# EasyEDA Pro project kuafu01_030内部老化方案_4.eprj, board PCB4 (continued)
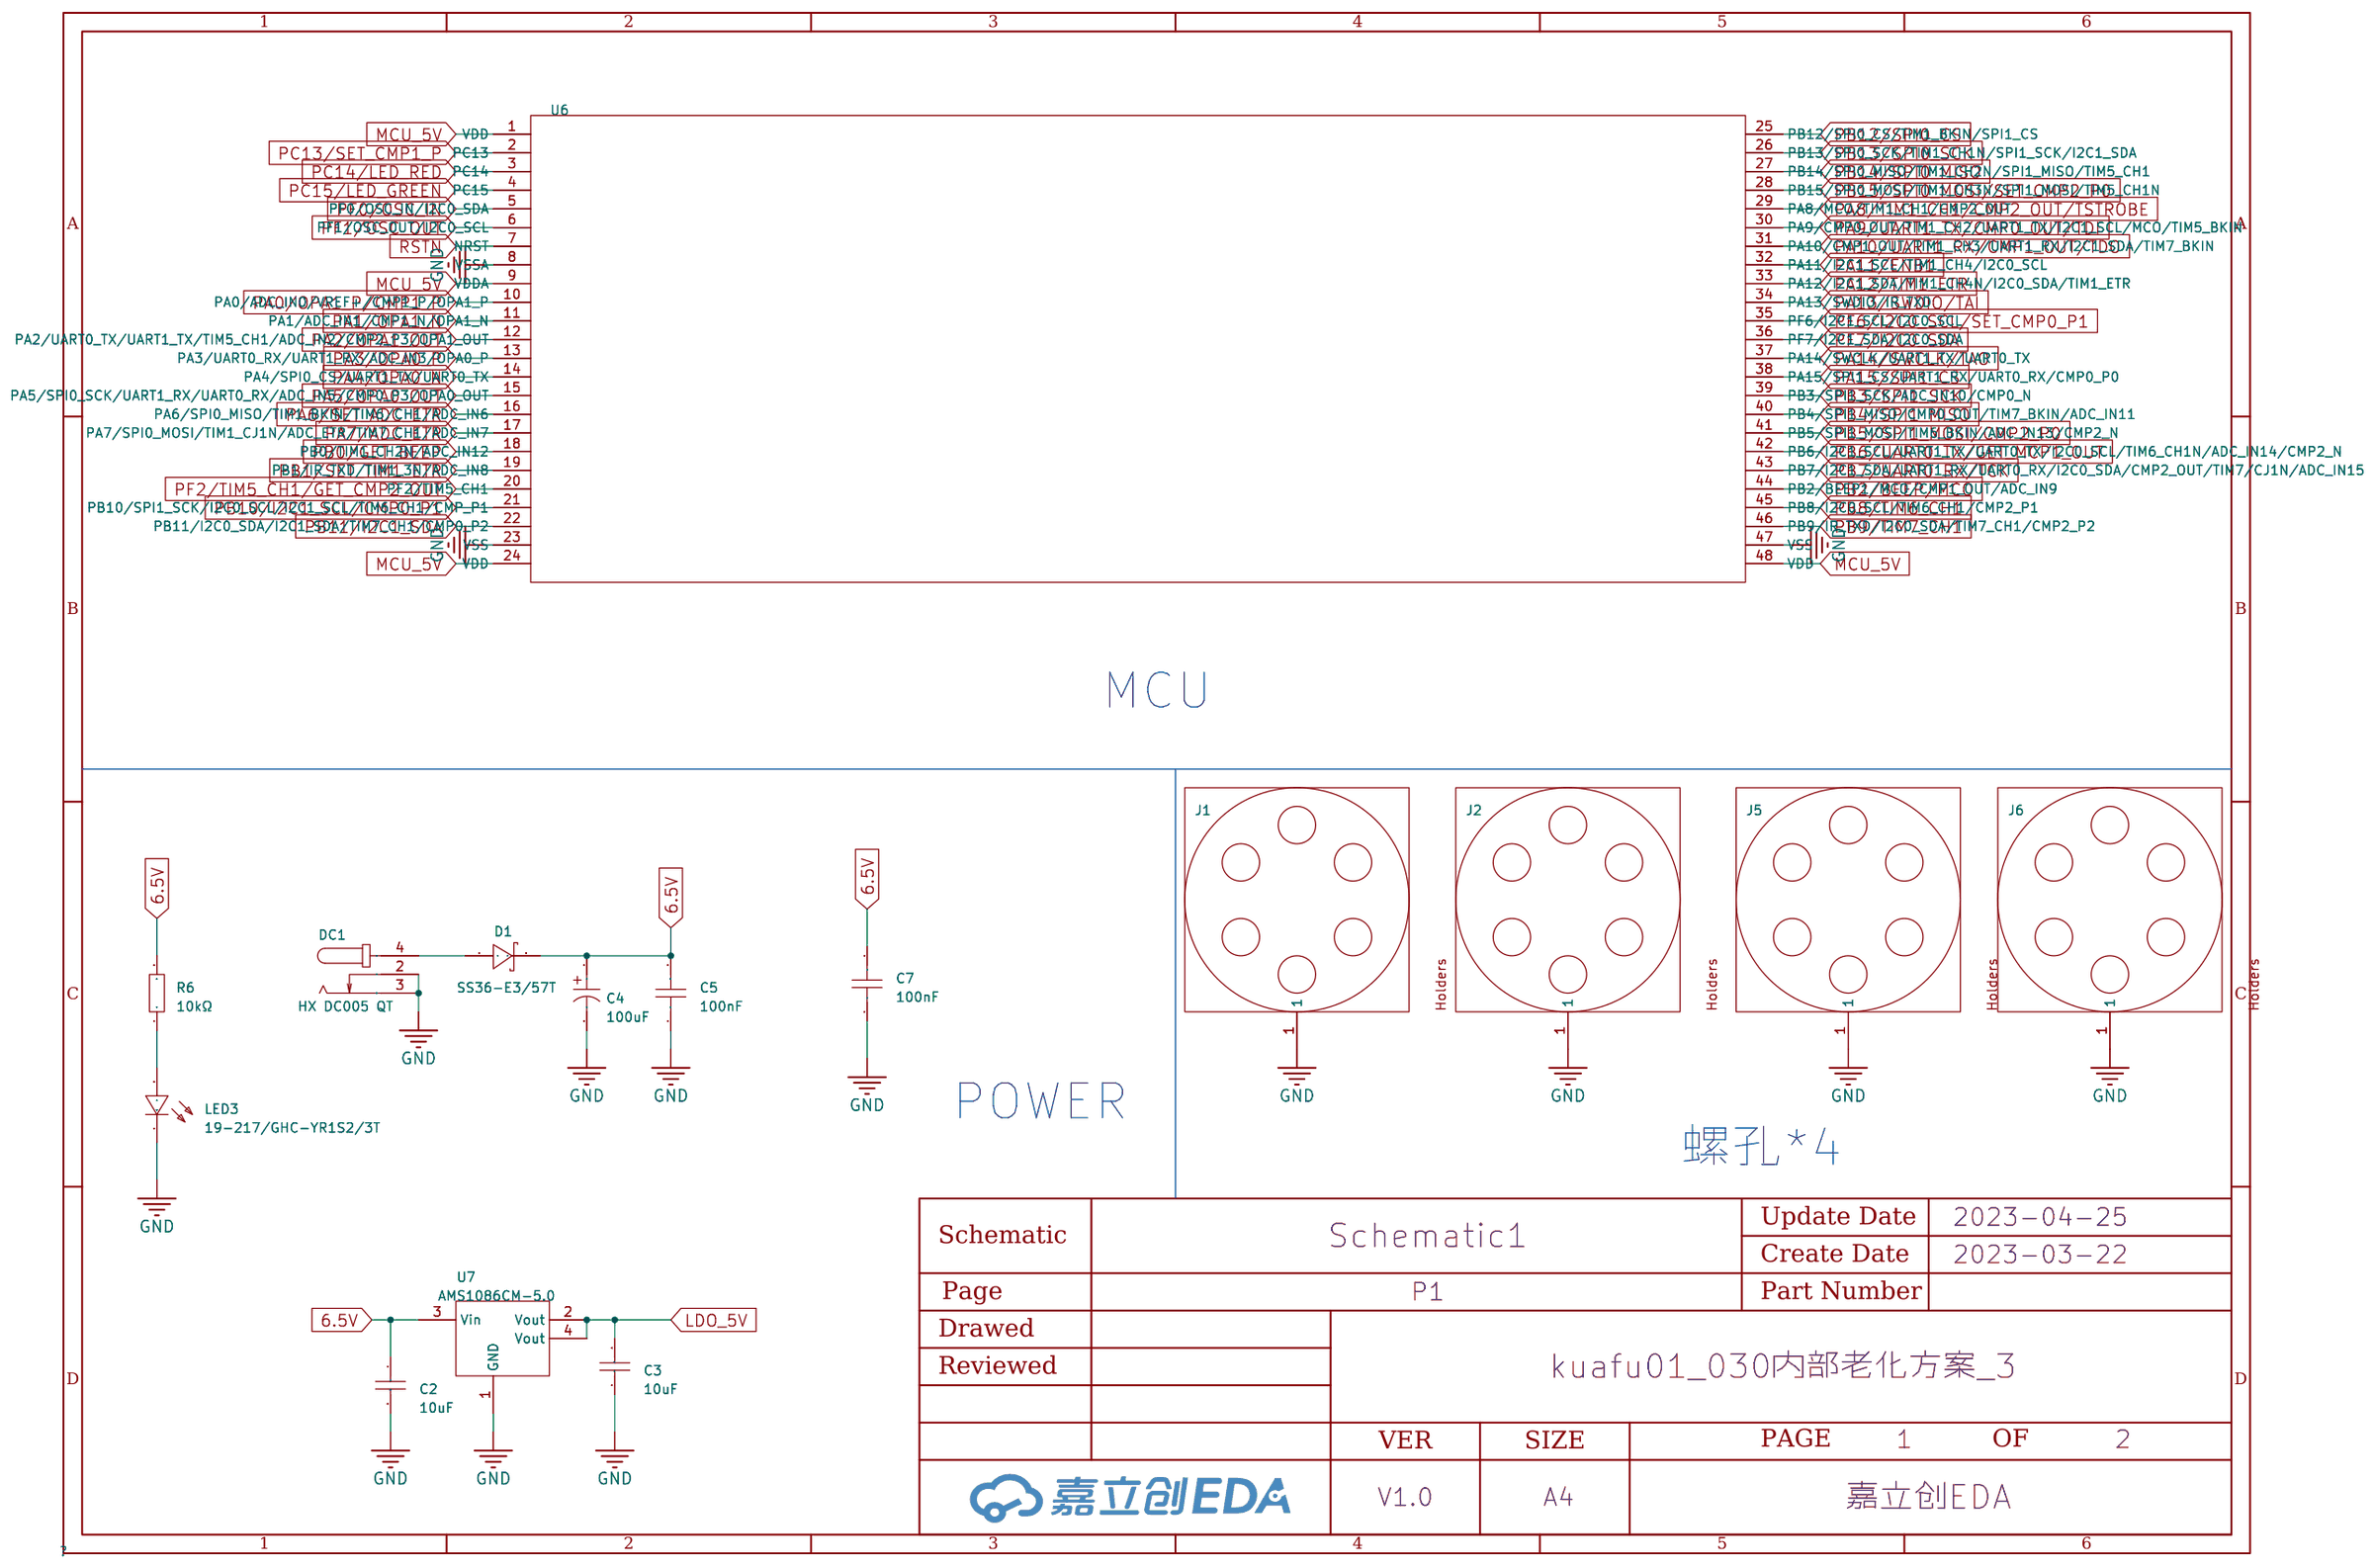
[diagram p0: P1]
## Routing (per net, layer and track width the routed paths; a pad name or vN(x,y) marks a point on that pad's centre or on a via; arc(x,y) is an arc through that point) (continued)
  Bottom Layer w0.28: v1(143.49,199.02) 143.5,199.03 v1(143.5,211.84) ; v1(244.58,86.25) 244.59,86.26 v1(244.59,99.07) ; v1(42.4,61.47) 42.4,48.66 v1(42.39,48.65) ; v1(143.5,61.47) 143.5,48.66 v1(143.49,48.65) ; v1(42.39,199.02) 42.4,199.03 v1(42.4,211.84) ; v1(244.58,123.84) 244.59,123.85 v1(244.59,136.66) ; v1(92.95,249.43) 92.95,236.62 v1(92.94,236.61) ; v1(42.4,249.43) 42.4,236.62 v1(42.39,236.61) ; v1(244.58,199.02) 244.59,199.03 v1(244.59,211.84) ; v1(42.39,123.84) 42.4,123.85 v1(42.4,136.66) ; v1(194.04,99.07) 194.04,86.26 v1(194.03,86.25) ; v1(194.03,161.43) 194.04,161.44 v1(194.04,174.25) ; v1(244.58,11.06) 244.59,11.07 v1(244.59,23.88) ; v1(143.5,249.43) 143.5,236.62 v1(143.49,236.61) ; v1(244.59,249.43) 244.59,236.62 v1(244.58,236.61) ; v1(42.4,99.07) 42.4,86.26 v1(42.39,86.25) ; v1(42.39,11.06) 42.4,11.07 v1(42.4,23.88) ; v1(92.94,161.43) 92.95,161.44 v1(92.95,174.25) ; v1(194.03,123.84) 194.04,123.85 v1(194.04,136.66) ; v1(194.03,199.02) 194.04,199.03 v1(194.04,211.84) ; v1(244.58,161.43) 244.59,161.44 v1(244.59,174.25) ; v1(244.58,48.65) 244.59,48.66 v1(244.59,61.47) ; v1(194.03,48.65) 194.04,48.66 v1(194.04,61.47) ; v1(42.39,161.43) 42.4,161.44 v1(42.4,174.25) ; v1(143.49,123.84) 143.5,123.85 v1(143.5,136.66) ; v1(194.04,249.43) 194.04,236.62 v1(194.03,236.61) ; v1(92.94,86.25) 92.95,86.26 v1(92.95,99.07) ; v1(92.94,199.02) 92.95,199.03 v1(92.95,211.84) ; v1(92.95,136.66) 92.95,123.85 v1(92.94,123.84) ; v1(143.49,161.43) 143.5,161.44 v1(143.5,174.25) ; v1(92.95,61.47) 92.95,48.66 v1(92.94,48.65) ; v1(143.5,99.07) 143.5,86.26 v1(143.49,86.25)
PA9/UART1_TX/CMP0_OUT/TDI: length 1156.4
  Top Layer w0.28: CN1#2.3 179.83,173.24 180.22,172.85 191.4,172.85 191.98,173.44 193.42,173.44 v1(193.44,173.46) ; v1(142.9,173.46) 142.88,173.44 141.44,173.44 140.85,172.85 129.67,172.85 129.29,173.24 CN1#7.3 ; v1(243.99,135.87) 243.97,135.85 242.53,135.85 241.94,135.26 230.76,135.26 230.38,135.65 CN1.3 ; U6#24.30 244.74,12.06 H4#23.1 ; v1(41.8,98.28) 41.78,98.26 40.34,98.26 39.76,97.67 28.58,97.67 28.19,98.05 CN1#14.3 ; v1(92.35,248.64) 92.33,248.62 90.89,248.62 90.3,248.04 79.12,248.04 78.74,248.42 CN1#32.3 ; U6#3.30 42.55,124.83 H4#3.1 ; U6#23.30 42.55,12.06 H4#22.1 ; v1(41.8,211.05) 41.78,211.03 40.34,211.03 39.76,210.45 28.58,210.45 28.19,210.83 CN1#27.3 ; CN1#20.3 78.74,98.05 79.12,97.67 90.3,97.67 90.89,98.26 92.33,98.26 v1(92.35,98.28) ; H4#6.1 194.19,124.83 U6#7.30 ; U6#20.30 42.55,87.24 H4#13.1 ; v1(142.9,248.64) 142.88,248.62 141.44,248.62 140.85,248.04 129.67,248.04 129.29,248.42 CN1#11.3 ; H4#32.1 93.1,237.61 U6.30 ; v1(142.9,98.28) 142.88,98.26 141.44,98.26 140.85,97.67 129.67,97.67 129.29,98.05 CN1#18.3 ; U6#32.30 194.19,200.02 H4#31.1 ; v1(243.99,248.64) 243.97,248.62 242.53,248.62 241.94,248.04 230.76,248.04 230.38,248.42 CN1#26.3 ; U6#10.30 194.19,162.42 H4#11.1 ; v1(243.99,173.46) 243.97,173.44 242.53,173.44 241.94,172.85 230.76,172.85 230.38,173.24 CN1#6.3 ; v1(92.35,135.87) 92.33,135.85 90.89,135.85 90.3,135.26 79.12,135.26 78.74,135.65 CN1#5.3 ; v1(92.35,211.05) 92.33,211.03 90.89,211.03 90.3,210.45 79.12,210.45 78.74,210.83 CN1#30.3 ; U6#25.30 194.19,237.61 H4#24.1 ; CN1#15.3 28.19,60.46 28.58,60.08 39.76,60.08 40.34,60.66 41.78,60.66 v1(41.8,60.68) ; H4#26.1 244.74,237.61 U6#26.30 ; H4#14.1 42.55,49.65 U6#14.30 ; v1(243.99,211.05) 243.97,211.03 242.53,211.03 241.94,210.45 230.76,210.45 230.38,210.83 CN1#29.3 ; H4#9.1 143.65,162.42 U6#8.30 ; U6#5.30 93.1,124.83 H4.1 ; CN1#31.3 129.29,210.83 129.67,210.45 140.85,210.45 141.44,211.03 142.88,211.03 v1(142.9,211.05) ; H4#17.1 194.19,49.65 U6#18.30 ; H4#2.1 42.55,162.42 U6#9.30 ; v1(142.9,60.68) 142.88,60.66 141.44,60.66 140.85,60.08 129.67,60.08 129.29,60.46 CN1#19.3 ; v1(142.9,135.87) 142.88,135.85 141.44,135.85 140.85,135.26 129.67,135.26 129.29,135.65 CN1#8.3 ; H4#30.1 143.65,200.02 U6#30.30 ; v1(193.44,135.87) 193.42,135.85 191.98,135.85 191.4,135.26 180.22,135.26 179.83,135.65 CN1#10.3 ; v1(193.44,211.05) 193.42,211.03 191.98,211.03 191.4,210.45 180.22,210.45 179.83,210.83 CN1#28.3 ; v1(193.44,98.28) 193.42,98.26 191.98,98.26 191.4,97.67 180.22,97.67 179.83,98.05 CN1#13.3 ; H4#20.1 143.65,87.24 U6#19.30 ; H4#7.1 244.74,162.42 U6#6.30 ; CN1#21.3 179.83,60.46 180.22,60.08 191.4,60.08 191.98,60.66 193.42,60.66 v1(193.44,60.68) ; H4#4.1 143.65,124.83 U6#2.30 ; v1(41.8,173.46) 41.78,173.44 40.34,173.44 39.76,172.85 28.58,172.85 28.19,173.24 CN1#3.3 ; H4#19.1 93.1,87.24 U6#22.30 ; H4#15.1 143.65,49.65 U6#13.30 ; H4#12.1 93.1,49.65 U6#16.30 ; CN1#17.3 230.38,98.05 230.76,97.67 241.94,97.67 242.53,98.26 243.97,98.26 v1(243.99,98.28) ; H4#5.1 244.74,124.83 U6#4.30 ; CN1#25.3 179.83,248.42 180.22,248.04 191.4,248.04 191.98,248.62 193.42,248.62 v1(193.44,248.64) ; v1(41.8,248.64) 41.78,248.62 40.34,248.62 39.76,248.04 28.58,248.04 28.19,248.42 CN1#24.3 ; H4#18.1 244.74,87.24 U6#17.30 ; v1(92.35,60.68) 92.33,60.66 90.89,60.66 90.3,60.08 79.12,60.08 78.74,60.46 CN1#16.3 ; v1(41.8,23.09) 41.78,23.07 40.34,23.07 39.76,22.49 28.58,22.49 28.19,22.87 CN1#22.3 ; H4#28.1 42.55,200.02 U6#31.30 ; U6#29.30 93.1,200.02 H4#29.1 ; CN1#9.3 78.74,173.24 79.12,172.85 90.3,172.85 90.89,173.44 92.33,173.44 v1(92.35,173.46) ; U6#15.30 244.74,49.65 H4#16.1 ; v1(243.99,60.68) 243.97,60.66 242.53,60.66 241.94,60.08 230.76,60.08 230.38,60.46 CN1#12.3 ; H4#25.1 42.55,237.61 U6#27.30 ; H4#21.1 194.19,87.24 U6#21.30 ; U6#12.30 143.65,237.61 H4#10.1 ; CN1#23.3 230.38,22.87 230.76,22.49 241.94,22.49 242.53,23.07 243.97,23.07 v1(243.99,23.09) ; H4#8.1 93.1,162.42 U6#11.30 ; v1(41.8,135.87) 41.78,135.85 40.34,135.85 39.76,135.26 28.58,135.26 28.19,135.65 CN1#4.3 ; U6#28.30 244.74,200.02 H4#27.1
  Bottom Layer w0.28: v1(243.99,173.46) 243.99,162.46 v1(243.98,162.45) ; v1(193.44,248.64) 193.44,237.64 v1(193.43,237.63) ; v1(142.89,200.04) 142.9,200.05 v1(142.9,211.05) ; v1(41.8,173.46) 41.8,162.46 v1(41.79,162.45) ; v1(243.98,237.63) 243.99,237.64 v1(243.99,248.64) ; v1(142.89,162.45) 142.9,162.46 v1(142.9,173.46) ; v1(243.99,135.87) 243.99,124.87 v1(243.98,124.86) ; v1(41.8,23.09) 41.8,12.09 v1(41.79,12.08) ; v1(142.9,135.87) 142.9,124.87 v1(142.89,124.86) ; v1(243.98,12.08) 243.99,12.09 v1(243.99,23.09) ; v1(41.79,200.04) 41.8,200.05 v1(41.8,211.05) ; v1(142.89,49.67) 142.9,49.68 v1(142.9,60.68) ; v1(243.99,211.05) 243.99,200.05 v1(243.98,200.04) ; v1(92.35,173.46) 92.35,162.46 v1(92.34,162.45) ; v1(193.44,173.46) 193.44,162.46 v1(193.43,162.45) ; v1(193.43,124.86) 193.44,124.87 v1(193.44,135.87) ; v1(142.9,248.64) 142.9,237.64 v1(142.89,237.63) ; v1(92.34,124.86) 92.35,124.87 v1(92.35,135.87) ; v1(193.43,200.04) 193.44,200.05 v1(193.44,211.05) ; v1(41.8,60.68) 41.8,49.68 v1(41.79,49.67) ; v1(92.34,87.27) 92.35,87.28 v1(92.35,98.28) ; v1(193.44,98.28) 193.44,87.28 v1(193.43,87.27) ; v1(41.79,237.63) 41.8,237.64 v1(41.8,248.64) ; v1(243.98,49.67) 243.99,49.68 v1(243.99,60.68) ; v1(92.34,237.63) 92.35,237.64 v1(92.35,248.64) ; v1(92.34,200.04) 92.35,200.05 v1(92.35,211.05) ; v1(142.9,98.28) 142.9,87.28 v1(142.89,87.27) ; v1(243.99,98.28) 243.99,87.28 v1(243.98,87.27) ; v1(193.44,60.68) 193.44,49.68 v1(193.43,49.67) ; v1(92.34,49.67) 92.35,49.68 v1(92.35,60.68) ; v1(41.8,135.87) 41.8,124.87 v1(41.79,124.86) ; v1(41.8,98.28) 41.8,87.28 v1(41.79,87.27)
PA10/UART1_RX/CMP1_OUT/TDO: length 1173.2
  Top Layer w0.28: U6#9.31 41.15,162.92 41.55,163.32 H3#6.1 ; v1(41.2,135.23) 40.33,135.23 39.94,134.83 26.14,134.83 25.65,135.32 CN1#4.1 ; U6#29.31 91.69,200.52 92.09,200.91 H3#30.1 ; U6#4.31 243.33,125.33 243.73,125.73 H3#7.1 ; v1(41.2,248) 40.33,248 39.94,247.61 26.14,247.61 25.65,248.09 CN1#24.1 ; CN1#20.1 76.2,97.72 76.69,97.24 90.48,97.24 90.88,97.64 v1(91.75,97.64) ; CN1#17.1 227.84,97.72 228.32,97.24 242.12,97.24 242.52,97.64 v1(243.39,97.64) ; v1(142.3,210.41) 141.43,210.41 141.03,210.01 127.23,210.01 126.75,210.5 CN1#31.1 ; U6#14.31 41.15,50.15 41.55,50.55 H3#14.1 ; H3#3.1 41.55,125.73 41.15,125.33 U6#3.31 ; U6#30.31 142.24,200.52 142.64,200.91 H3#31.1 ; v1(243.39,22.45) 242.52,22.45 242.12,22.05 228.32,22.05 227.84,22.54 CN1#23.1 ; U6#31.31 41.15,200.52 41.55,200.91 H3#29.1 ; v1(91.75,60.04) 90.88,60.04 90.48,59.65 76.69,59.65 76.2,60.13 CN1#16.1 ; U6#11.31 91.69,162.92 92.09,163.32 H3#10.1 ; U6#13.31 142.24,50.15 142.64,50.55 H3#16.1 ; U6#22.31 91.69,87.74 92.09,88.14 H3#21.1 ; v1(192.84,97.64) 191.97,97.64 191.57,97.24 177.78,97.24 177.29,97.72 CN1#13.1 ; U6#19.31 142.24,87.74 142.64,88.14 H3#20.1 ; v1(41.2,60.04) 40.33,60.04 39.94,59.65 26.14,59.65 25.65,60.13 CN1#15.1 ; CN1#28.1 177.29,210.5 177.78,210.01 191.57,210.01 191.97,210.41 v1(192.84,210.41) ; H3#4.1 243.73,163.32 243.33,162.92 U6#6.31 ; v1(91.75,135.23) 90.88,135.23 90.48,134.83 76.69,134.83 76.2,135.32 CN1#5.1 ; H3#13.1 92.09,50.55 91.69,50.15 U6#16.31 ; v1(91.75,172.82) 90.88,172.82 90.48,172.42 76.69,172.42 76.2,172.91 CN1#9.1 ; v1(192.84,248) 191.97,248 191.57,247.61 177.78,247.61 177.29,248.09 CN1#25.1 ; U6#32.31 192.79,200.52 193.18,200.91 H3#32.1 ; H3#28.1 243.73,200.91 243.33,200.52 U6#28.31 ; CN1#14.1 25.65,97.72 26.14,97.24 39.94,97.24 40.33,97.64 v1(41.2,97.64) ; CN1#3.1 25.65,172.91 26.14,172.42 39.94,172.42 40.33,172.82 v1(41.2,172.82) ; v1(243.39,172.82) 242.52,172.82 242.12,172.42 228.32,172.42 227.84,172.91 CN1#6.1 ; U6#17.31 243.33,87.74 243.73,88.14 H3#15.1 ; U6#10.31 192.79,162.92 193.18,163.32 H3#11.1 ; U6#18.31 192.79,50.15 193.18,50.55 H3#19.1 ; v1(91.75,210.41) 90.88,210.41 90.48,210.01 76.69,210.01 76.2,210.5 CN1#30.1 ; H3#27.1 243.73,238.51 243.33,238.11 U6#26.31 ; CN1#7.1 126.75,172.91 127.23,172.42 141.03,172.42 141.43,172.82 v1(142.3,172.82) ; H3#22.1 193.18,88.14 192.79,87.74 U6#21.31 ; H3#2.1 92.09,125.73 91.69,125.33 U6#5.31 ; H3#26.1 193.18,238.51 192.79,238.11 U6#25.31 ; H3#18.1 243.73,50.55 243.33,50.15 U6#15.31 ; U6#12.31 142.24,238.11 142.64,238.51 H3#12.1 ; CN1#29.1 227.84,210.5 228.32,210.01 242.12,210.01 242.52,210.41 v1(243.39,210.41) ; CN1#27.1 25.65,210.5 26.14,210.01 39.94,210.01 40.33,210.41 v1(41.2,210.41) ; H3#23.1 41.55,12.95 41.15,12.56 U6#23.31 ; U6#24.31 243.33,12.56 243.73,12.95 H3#24.1 ; CN1#10.1 177.29,135.32 177.78,134.83 191.57,134.83 191.97,135.23 v1(192.84,135.23) ; v1(142.3,248) 141.43,248 141.03,247.61 127.23,247.61 126.75,248.09 CN1#11.1 ; v1(243.39,135.23) 242.52,135.23 242.12,134.83 228.32,134.83 227.84,135.32 CN1.1 ; CN1#22.1 25.65,22.54 26.14,22.05 39.94,22.05 40.33,22.45 v1(41.2,22.45) ; v1(192.84,172.82) 191.97,172.82 191.57,172.42 177.78,172.42 177.29,172.91 CN1#2.1 ; U6#2.31 142.24,125.33 142.64,125.73 H3#5.1 ; v1(142.3,60.04) 141.43,60.04 141.03,59.65 127.23,59.65 126.75,60.13 CN1#19.1 ; H3.1 92.09,238.51 91.69,238.11 U6.31 ; U6#8.31 142.24,162.92 142.64,163.32 H3#9.1 ; H3#25.1 41.55,238.51 41.15,238.11 U6#27.31 ; v1(142.3,97.64) 141.43,97.64 141.03,97.24 127.23,97.24 126.75,97.72 CN1#18.1 ; v1(243.39,60.04) 242.52,60.04 242.12,59.65 228.32,59.65 227.84,60.13 CN1#12.1 ; v1(142.3,135.23) 141.43,135.23 141.03,134.83 127.23,134.83 126.75,135.32 CN1#8.1 ; v1(192.84,60.04) 191.97,60.04 191.57,59.65 177.78,59.65 177.29,60.13 CN1#21.1 ; v1(91.75,248) 90.88,248 90.48,247.61 76.69,247.61 76.2,248.09 CN1#32.1 ; H3#8.1 193.18,125.73 192.79,125.33 U6#7.31 ; H3#17.1 41.55,88.14 41.15,87.74 U6#20.31 ; v1(243.39,248) 242.52,248 242.12,247.61 228.32,247.61 227.84,248.09 CN1#26.1
  Bottom Layer w0.28: v1(243.37,238.18) 243.39,238.2 v1(243.39,248) ; v1(91.75,60.04) 91.75,50.24 v1(91.73,50.22) ; v1(142.3,60.04) 142.3,50.24 v1(142.28,50.22) ; v1(192.82,50.22) 192.84,50.24 v1(192.84,60.04) ; v1(243.37,87.82) 243.39,87.84 v1(243.39,97.64) ; v1(243.37,163) 243.39,163.02 v1(243.39,172.82) ; v1(243.37,125.41) 243.39,125.43 v1(243.39,135.23) ; v1(142.3,172.82) 142.3,163.02 v1(142.28,163) ; v1(41.2,135.23) 41.2,125.43 v1(41.18,125.41) ; v1(41.18,12.63) 41.2,12.65 v1(41.2,22.45) ; v1(142.3,248) 142.3,238.2 v1(142.28,238.18) ; v1(243.37,50.22) 243.39,50.24 v1(243.39,60.04) ; v1(91.73,163) 91.75,163.02 v1(91.75,172.82) ; v1(41.2,248) 41.2,238.2 v1(41.18,238.18) ; v1(91.75,248) 91.75,238.2 v1(91.73,238.18) ; v1(91.75,135.23) 91.75,125.43 v1(91.73,125.41) ; v1(192.84,97.64) 192.84,87.84 v1(192.82,87.82) ; v1(192.84,210.41) 192.84,200.61 v1(192.82,200.59) ; v1(192.84,248) 192.84,238.2 v1(192.82,238.18) ; v1(41.18,50.22) 41.2,50.24 v1(41.2,60.04) ; v1(142.28,200.59) 142.3,200.61 v1(142.3,210.41) ; v1(41.2,172.82) 41.2,163.02 v1(41.18,163) ; v1(192.84,172.82) 192.84,163.02 v1(192.82,163) ; v1(243.39,22.45) 243.39,12.65 v1(243.37,12.63) ; v1(243.37,200.59) 243.39,200.61 v1(243.39,210.41) ; v1(142.3,135.23) 142.3,125.43 v1(142.28,125.41) ; v1(41.18,87.82) 41.2,87.84 v1(41.2,97.64) ; v1(142.28,87.82) 142.3,87.84 v1(142.3,97.64) ; v1(192.84,135.23) 192.84,125.43 v1(192.82,125.41) ; v1(41.2,210.41) 41.2,200.61 v1(41.18,200.59) ; v1(91.73,200.59) 91.75,200.61 v1(91.75,210.41) ; v1(91.75,97.64) 91.75,87.84 v1(91.73,87.82)
PA11/ENB1: length 325.5
  Top Layer w0.28: U6#12.32 141.69,238.61 144.12,241.05 H6#12.2 ; H6#25.2 43.03,241.05 40.59,238.61 U6#27.32 ; H6#4.2 43.03,128.27 40.59,125.83 U6#3.32 ; H6#20.2 144.12,90.68 141.69,88.24 U6#19.32 ; U6#30.32 141.69,201.02 144.12,203.45 H6#30.2 ; H6#10.2 194.67,165.86 192.23,163.42 U6#10.32 ; H6#13.2 93.58,53.09 91.14,50.65 U6#16.32 ; U6.32 91.14,238.61 93.58,241.05 H6.2 ; H6#2.2 93.58,128.27 91.14,125.83 U6#5.32 ; U6#15.32 242.78,50.65 245.22,53.09 H6#18.2 ; H6#24.2 245.22,15.49 242.78,13.06 U6#24.32 ; H6#31.2 194.67,203.45 192.23,201.02 U6#32.32 ; H6#23.2 43.03,15.49 40.59,13.06 U6#23.32 ; U6#9.32 40.59,163.42 43.03,165.86 H6#3.2 ; H6#22.2 93.58,90.68 91.14,88.24 U6#22.32 ; H6#17.2 144.12,53.09 141.69,50.65 U6#13.32 ; H6#14.2 43.03,90.68 40.59,88.24 U6#20.32 ; U6#8.32 141.69,163.42 144.12,165.86 H6#9.2 ; H6#7.2 245.22,128.27 242.78,125.83 U6#4.32 ; U6#6.32 242.78,163.42 245.22,165.86 H6#5.2 ; H6#29.2 43.03,203.45 40.59,201.02 U6#31.32 ; H6#28.2 245.22,203.45 242.78,201.02 U6#28.32 ; U6#14.32 40.59,50.65 43.03,53.09 H6#15.2 ; U6#18.32 192.23,50.65 194.67,53.09 H6#19.2 ; U6#29.32 91.14,201.02 93.58,203.45 H6#32.2 ; H6#16.2 245.22,90.68 242.78,88.24 U6#17.32 ; U6#11.32 91.14,163.42 93.58,165.86 H6#11.2 ; U6#25.32 192.23,238.61 194.67,241.05 H6#26.2 ; U6#26.32 242.78,238.61 245.22,241.05 H6#27.2 ; H6#8.2 194.67,128.27 192.23,125.83 U6#7.32 ; H6#6.2 144.12,128.27 141.69,125.83 U6#2.32 ; H6#21.2 194.67,90.68 192.23,88.24 U6#21.32
PA12/TIM1_ETR: length 709.8
  Top Layer w0.28: U6#10.33 189.51,163.92 v1(189.56,163.98) ; 182.72,45.7 182.72,42.3 v1(183.25,41.77) ; U6#20.33 37.87,88.74 v1(37.92,88.8) ; v1(240.11,51.2) 240.05,51.15 U6#15.33 ; v1(233.8,41.77) 233.27,42.3 233.27,45.7 ; U6#12.33 138.96,239.11 v1(139.02,239.16) ; v1(240.11,13.61) 240.05,13.56 U6#24.33 ; U6#22.33 88.41,88.74 v1(88.47,88.8) ; 182.72,196.06 182.72,192.67 v1(183.25,192.14) ; v1(132.71,192.14) 132.18,192.67 132.18,196.06 ; v1(37.92,126.39) 37.87,126.33 U6#3.33 ; v1(132.71,79.37) 132.18,79.9 132.18,83.29 ; U6#29.33 88.41,201.52 v1(88.47,201.57) ; v1(88.47,163.98) 88.41,163.92 U6#11.33 ; 81.63,196.06 81.63,192.67 v1(82.16,192.14) ; v1(189.56,239.16) 189.51,239.11 U6#25.33 ; v1(31.61,229.73) 31.08,230.26 31.08,233.66 ; v1(240.11,163.98) 240.05,163.92 U6#6.33 ; v1(31.61,4.18) 31.08,4.71 31.08,8.1 ; v1(37.92,163.98) 37.87,163.92 U6#9.33 ; U6.33 88.41,239.11 v1(88.47,239.16) ; v1(132.71,229.73) 132.18,230.26 132.18,233.66 ; 182.72,83.29 182.72,79.9 v1(183.25,79.37) ; 132.18,158.47 132.18,155.08 v1(132.71,154.55) ; U6#21.33 189.51,88.74 v1(189.56,88.8) ; v1(37.92,201.57) 37.87,201.52 U6#31.33 ; v1(139.02,201.57) 138.96,201.52 U6#30.33 ; v1(82.16,116.96) 81.63,117.49 81.63,120.88 ; v1(31.61,154.55) 31.08,155.08 31.08,158.47 ; v1(139.02,51.2) 138.96,51.15 U6#13.33 ; 81.63,233.66 81.63,230.26 v1(82.16,229.73) ; U6#5.33 88.41,126.33 v1(88.47,126.39) ; 81.63,83.29 81.63,79.9 v1(82.16,79.37) ; v1(189.56,126.39) 189.51,126.33 U6#7.33 ; U6#16.33 88.41,51.15 v1(88.47,51.2) ; v1(31.61,116.96) 31.08,117.49 31.08,120.88 ; v1(82.16,41.77) 81.63,42.3 81.63,45.7 ; v1(189.56,51.2) 189.51,51.15 U6#18.33 ; v1(132.71,41.77) 132.18,42.3 132.18,45.7 ; U6#32.33 189.51,201.52 v1(189.56,201.57) ; 132.18,120.88 132.18,117.49 v1(132.71,116.96) ; U6#23.33 37.87,13.56 v1(37.92,13.61) ; v1(233.8,116.96) 233.27,117.49 233.27,120.88 ; U6#17.33 240.05,88.74 v1(240.11,88.8) ; 233.27,233.66 233.27,230.26 v1(233.8,229.73) ; 31.08,196.06 31.08,192.67 v1(31.61,192.14) ; 31.08,83.29 31.08,79.9 v1(31.61,79.37) ; v1(233.8,192.14) 233.27,192.67 233.27,196.06 ; U6#14.33 37.87,51.15 v1(37.92,51.2) ; 182.72,120.88 182.72,117.49 v1(183.25,116.96) ; 233.27,158.47 233.27,155.08 v1(233.8,154.55) ; v1(233.8,79.37) 233.27,79.9 233.27,83.29 ; v1(37.92,239.16) 37.87,239.11 U6#27.33 ; U6#28.33 240.05,201.52 v1(240.11,201.57) ; v1(82.16,154.55) 81.63,155.08 81.63,158.47 ; 182.72,233.66 182.72,230.26 v1(183.25,229.73) ; v1(240.11,126.39) 240.05,126.33 U6#4.33 ; v1(240.11,239.16) 240.05,239.11 U6#26.33 ; U6#8.33 138.96,163.92 v1(139.02,163.98) ; 233.27,8.1 233.27,4.71 v1(233.8,4.18) ; v1(31.61,41.77) 31.08,42.3 31.08,45.7 ; v1(183.25,154.55) 182.72,155.08 182.72,158.47 ; U6#19.33 138.96,88.74 v1(139.02,88.8) ; v1(139.02,126.39) 138.96,126.33 U6#2.33
  Bottom Layer w0.28: v1(233.8,4.18) 239.06,4.18 240.09,5.21 240.09,13.59 v1(240.11,13.61) ; v1(88.47,88.8) 88.45,88.78 88.45,80.4 87.42,79.37 v1(82.16,79.37) ; v1(189.56,126.39) 189.54,126.37 189.54,117.99 188.51,116.96 v1(183.25,116.96) ; v1(132.71,154.55) 137.97,154.55 139,155.58 139,163.96 v1(139.02,163.98) ; v1(233.8,116.96) 239.06,116.96 240.09,117.99 240.09,126.37 v1(240.11,126.39) ; v1(31.61,192.14) 36.87,192.14 37.91,193.17 37.91,201.55 v1(37.92,201.57) ; v1(139.02,201.57) 139,201.55 139,193.17 137.97,192.14 v1(132.71,192.14) ; v1(82.16,229.73) 87.42,229.73 88.45,230.77 88.45,239.15 v1(88.47,239.16) ; v1(132.71,79.37) 137.97,79.37 139,80.4 139,88.78 v1(139.02,88.8) ; v1(189.56,51.2) 189.54,51.19 189.54,42.81 188.51,41.77 v1(183.25,41.77) ; v1(240.11,51.2) 240.09,51.19 240.09,42.81 239.06,41.77 v1(233.8,41.77) ; v1(183.25,154.55) 188.51,154.55 189.54,155.58 189.54,163.96 v1(189.56,163.98) ; v1(189.56,201.57) 189.54,201.55 189.54,193.17 188.51,192.14 v1(183.25,192.14) ; v1(37.92,51.2) 37.91,51.19 37.91,42.81 36.87,41.77 v1(31.61,41.77) ; v1(37.92,163.98) 37.91,163.96 37.91,155.58 36.87,154.55 v1(31.61,154.55) ; v1(88.47,51.2) 88.45,51.19 88.45,42.81 87.42,41.77 v1(82.16,41.77) ; v1(37.92,126.39) 37.91,126.37 37.91,117.99 36.87,116.96 v1(31.61,116.96) ; v1(240.11,88.8) 240.09,88.78 240.09,80.4 239.06,79.37 v1(233.8,79.37) ; v1(82.16,154.55) 87.42,154.55 88.45,155.58 88.45,163.96 v1(88.47,163.98) ; v1(31.61,4.18) 36.87,4.18 37.91,5.21 37.91,13.59 v1(37.92,13.61) ; v1(139.02,51.2) 139,51.19 139,42.81 137.97,41.77 v1(132.71,41.77) ; v1(31.61,229.73) 36.87,229.73 37.91,230.77 37.91,239.15 v1(37.92,239.16) ; v1(88.47,126.39) 88.45,126.37 88.45,117.99 87.42,116.96 v1(82.16,116.96) ; v1(132.71,116.96) 137.97,116.96 139,117.99 139,126.37 v1(139.02,126.39) ; v1(37.92,88.8) 37.91,88.78 37.91,80.4 36.87,79.37 v1(31.61,79.37) ; v1(183.25,229.73) 188.51,229.73 189.54,230.77 189.54,239.15 v1(189.56,239.16) ; v1(88.47,201.57) 88.45,201.55 88.45,193.17 87.42,192.14 v1(82.16,192.14) ; v1(233.8,192.14) 239.06,192.14 240.09,193.17 240.09,201.55 v1(240.11,201.57) ; v1(189.56,88.8) 189.54,88.78 189.54,80.4 188.51,79.37 v1(183.25,79.37) ; v1(240.11,239.16) 240.09,239.15 240.09,230.77 239.06,229.73 v1(233.8,229.73) ; v1(132.71,229.73) 137.97,229.73 139,230.77 139,239.15 v1(139.02,239.16) ; v1(240.11,163.98) 240.09,163.96 240.09,155.58 239.06,154.55 v1(233.8,154.55)
